# EasyEDA Pro project Athena.eprj, board PCB
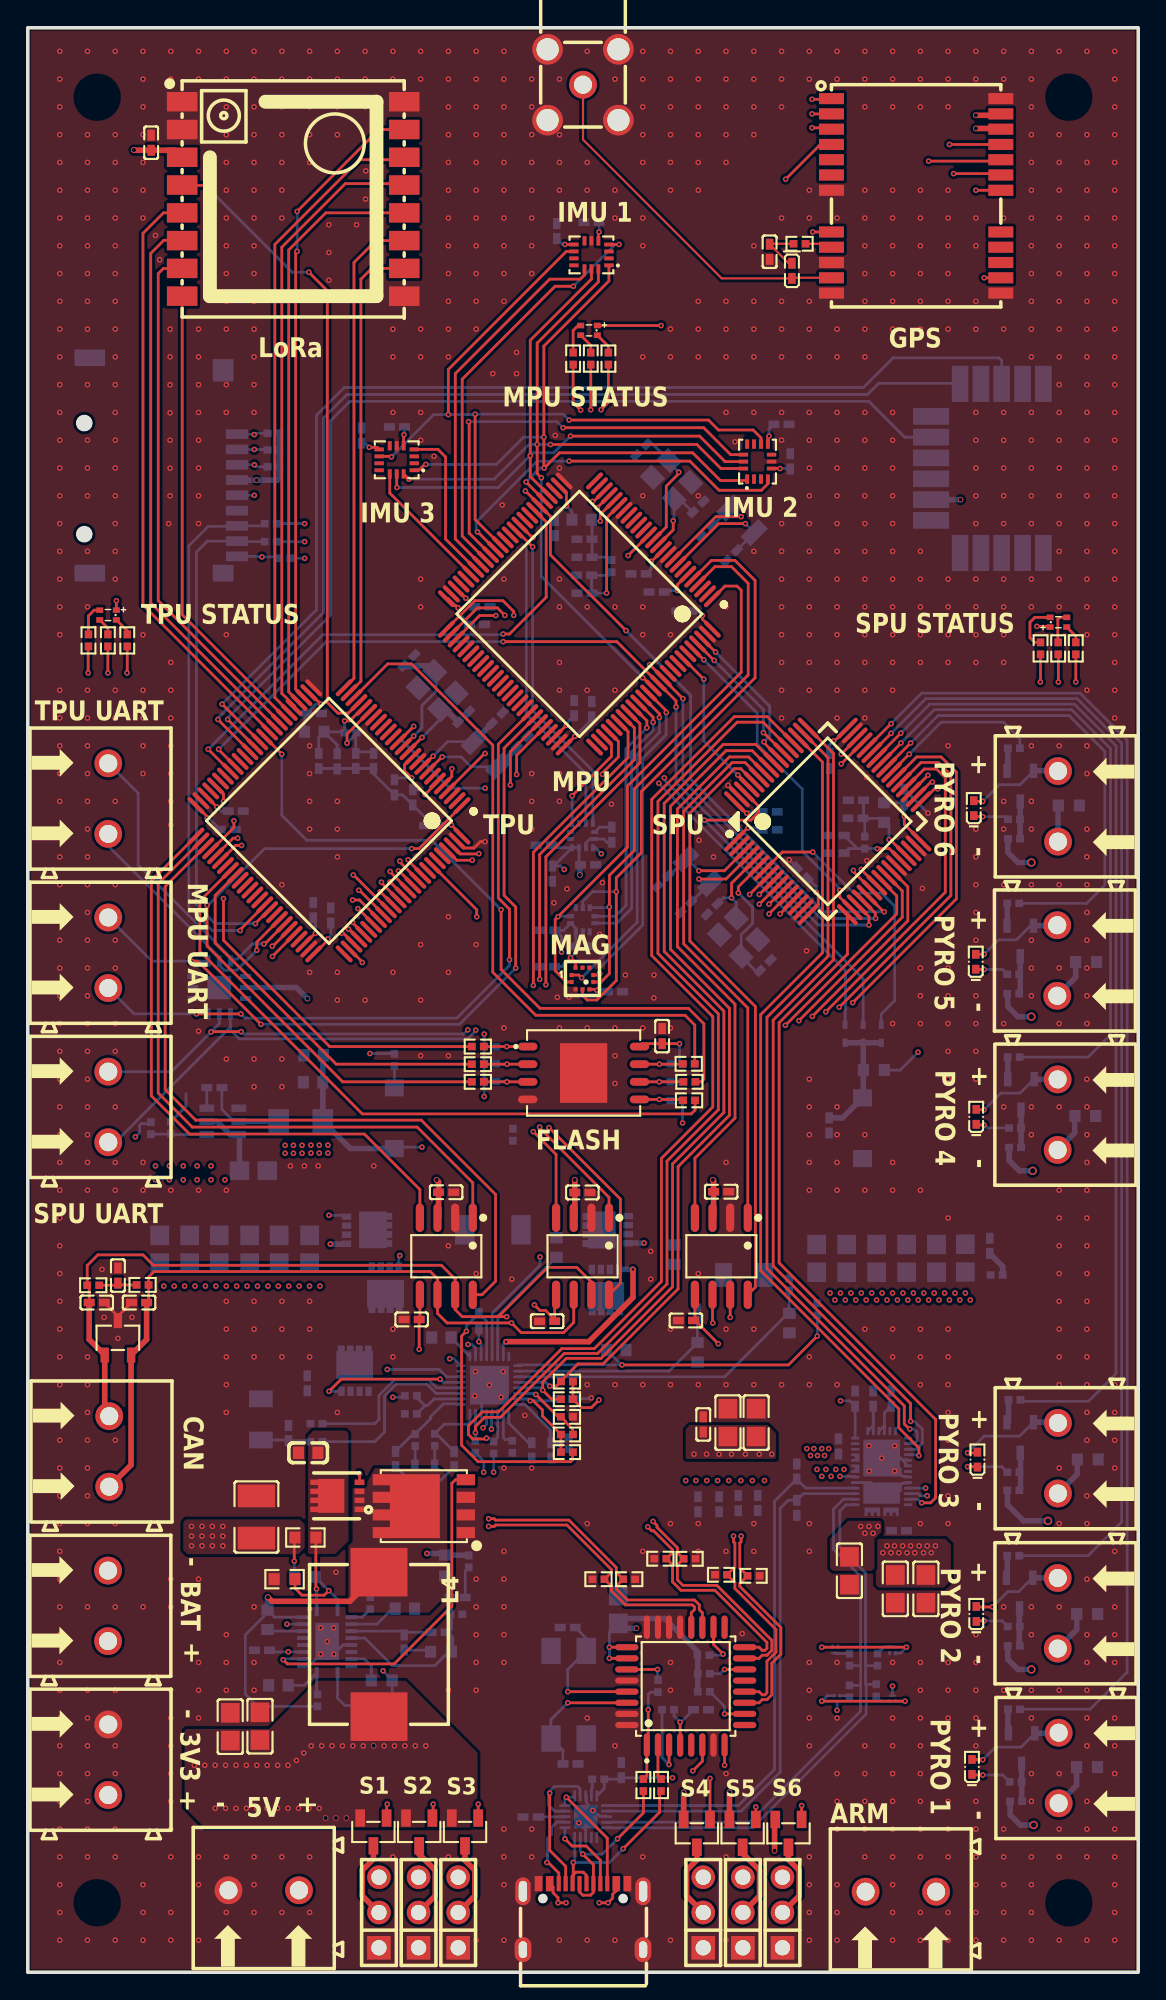
[diagram p4: board, top side]
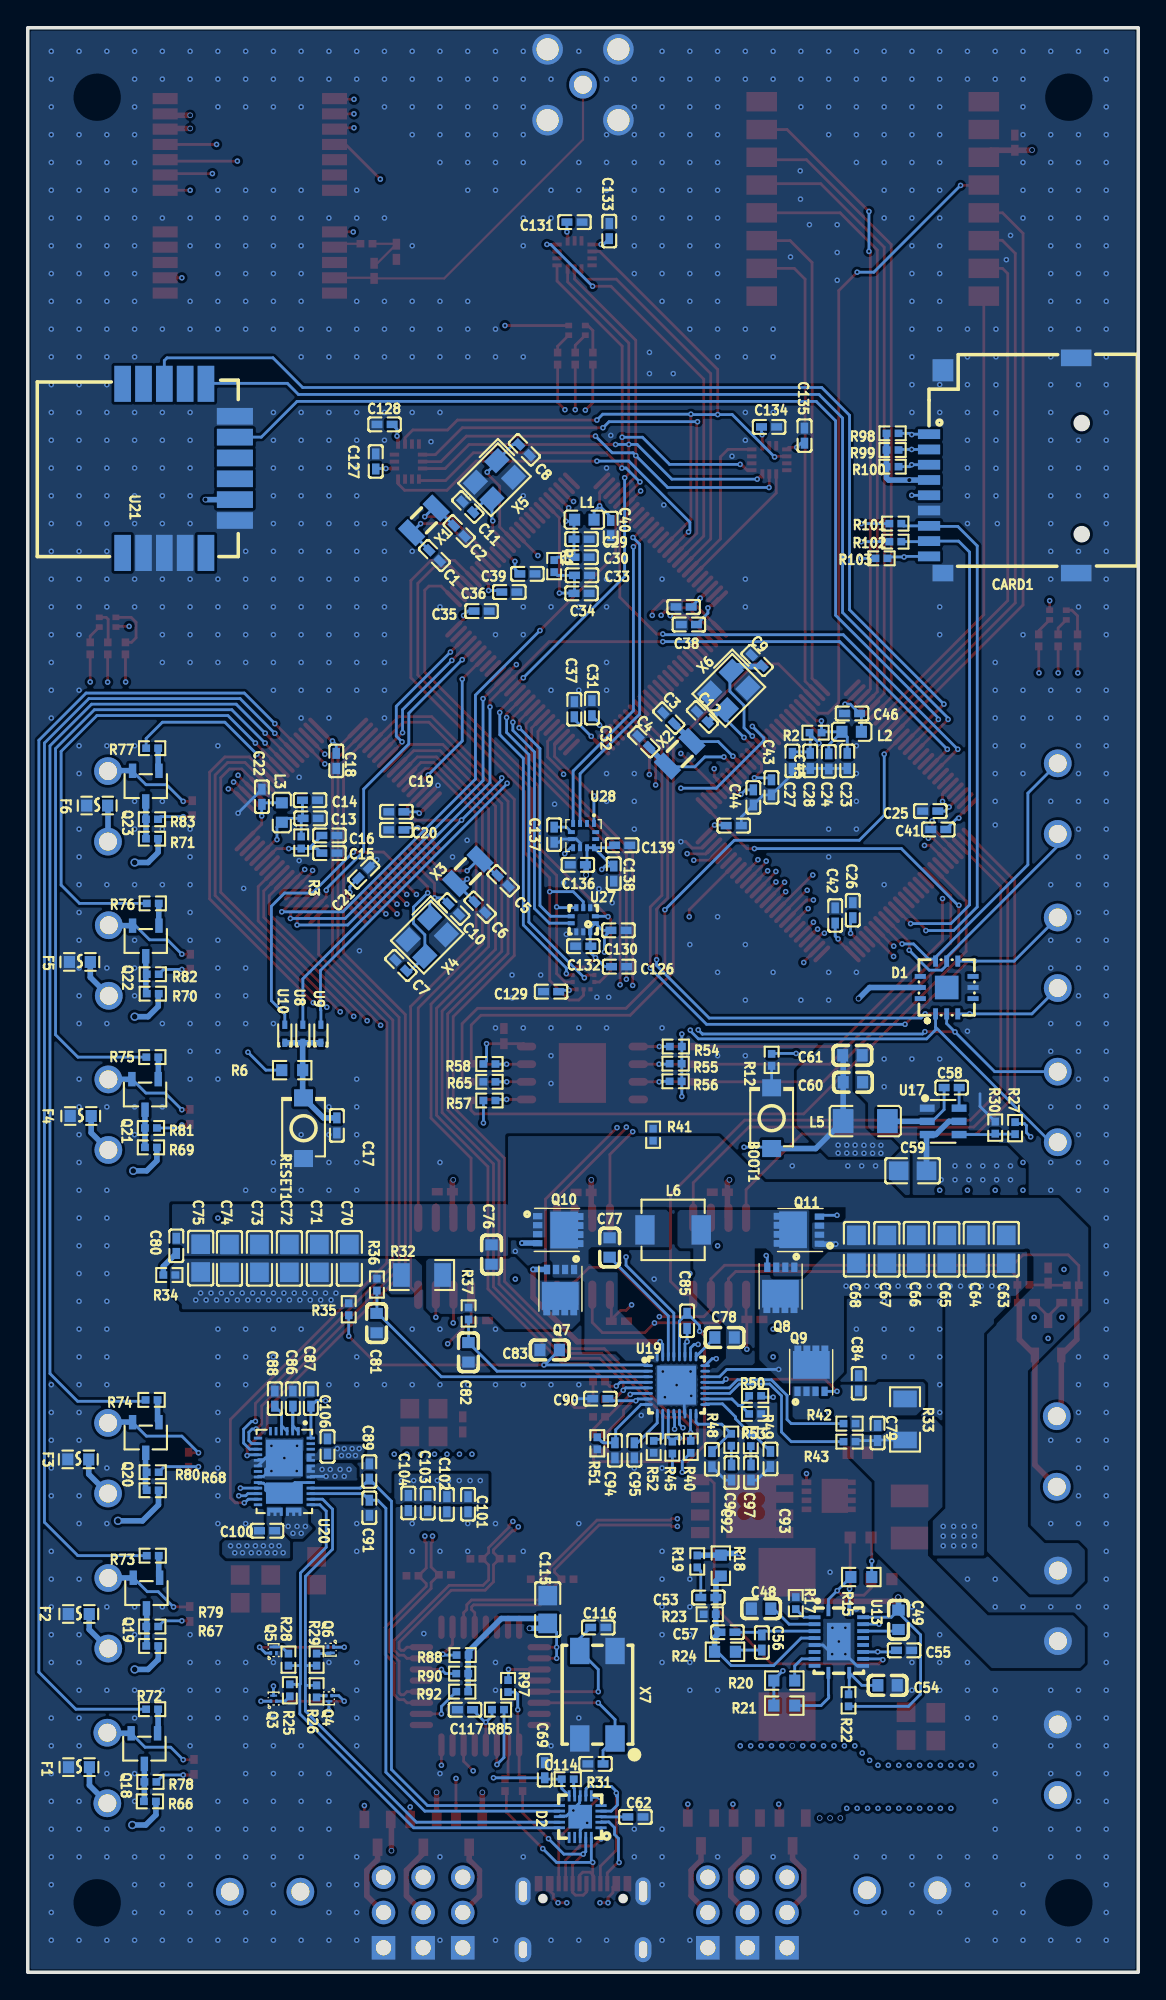
[diagram p5: board, bottom side, seen from below]

Outline 80 x 140 mm; copper layers: Top Layer, GND, POWER, SIGNAL, GND2, Bottom Layer. Coordinates in mm from the lower left corner of the outline.
Outline path: rectangle 0,140 80,0
Stack: Top Layer 0.035mm Outer layer thickness 1oz / Dielectric1 0.0994mm 3313 RC57% 4.2mil / GND 0.0152mm Inner layer thickness / Dielectric2 0.55mm 0.55mm H/H No copper / POWER 0.0152mm Inner layer thickness / Dielectric3 0.1088mm 2116 RC54% 4.9mil / SIGNAL 0.0152mm Inner layer thickness / Dielectric4 0.55mm 0.55mm H/H No copper / GND2 0.0152mm Inner layer thickness / Dielectric5 0.0994mm 3313 RC57% 4.2mil / Bottom Layer 0.035mm Outer layer thickness 1oz

## Design rules (mm)
net TPU_DP: DP1
net TPU_DM: DP1
net MPU_DP: DP2
net MPU_DM: DP2
net SPU_DP: DP3
net SPU_DM: DP3
template: Custom Config
spacing copperThickness1oz (default): track to track 0.102, other pairs 0.152 to 0.3
spacing copperThickness2oz: track to track 0.203, other pairs 0.152 to 0.3
spacing copperThicknessInner0.5oz: track to track 0.089, other pairs 0.152 to 0.3
track width copperThickness1oz (default): min 0.102, default 0.254, max 2.54
track width copperThickness2oz: min 0.203, default 0.254, max 2.54
track width copperThickness0.5oz: min 0.089, default 0.254, max 2.54
differential pair differentialPair (default): width min 0.127, default 0.254, max 2.54; gap min 0.152, default 0.152
via viaSize (default): diameter min 0.4, default 0.4, max 10; hole min 0.2, default 0.2, max 6.3

## Placement (name value [footprint] x y rotation side)
ARM1  WJ500V-5.08-2P  [CONN-TH_2P-P5.00_WJ500V-5.08-2P]  62.9 5.8 180 top
BOOT1  6.8pF  [SW-SMD_L3.9-W3.0-P4.45]  26.41 61.49 90 bottom
C1  6.8pF  [C0402]  50.7 102 225 bottom
C2  6.8pF  [C0402]  48.92 103.77 225 bottom
C3  6.8pF  [C0402]  35.62 88.6 45 bottom
C4  6.8pF  [C0402]  33.82 90.3 45 bottom
C5  6.8pF  [C0402]  45.76 78.58 225 bottom
C6  6.8pF  [C0402]  47.42 76.68 225 bottom
C7  20pF  [C0402]  53.12 72.49 45 bottom
C8  20pF  [C0402]  44.22 109.61 225 bottom
C9  20pF  [C0402]  27.46 94.45 45 bottom
C10  20pF  [C0402]  49.31 76.55 225 bottom
C11  3.9pF  [C0402]  48.3 105.5 45 bottom
C12  20pF  [C0402]  31.4 90.38 45 bottom
C13  100nF  [C0402]  59.63 83.08 180 bottom
C14  1uF  [C0402]  59.66 84.39 0 bottom
C15  100nF  [C0402]  58.27 80.58 180 bottom
C16  1uF  [C0402]  58.27 81.85 0 bottom
C17  100nF  [C0402]  57.73 60.97 270 bottom
C18  100nF  [C0402]  57.78 87.21 270 bottom
C19  100nF  [C0402]  53.45 83.55 0 bottom
C20  100nF  [C0402]  53.45 82.25 0 bottom
C21  100nF  [C0402]  55.8 79.15 135 bottom
C22  4.7uF  [C0402]  63.13 84.63 270 bottom
C23  100nF  [C0402]  20.96 87.22 270 bottom
C24  1uF  [C0402]  22.29 87.18 90 bottom
C25  2.2uF  [C0402]  14.98 83.6 0 bottom
C26  2.2uF  [C0402]  20.56 76.47 90 bottom
C27  100nF  [C0402]  24.91 87.21 270 bottom
C28  1uF  [C0402]  23.63 87.22 90 bottom
C29  100nF  [C0402]  40.1 103.18 180 bottom
C30  1uF  [C0402]  40.1 101.88 0 bottom
C31  2.2uF  [C0402]  39.36 91.01 90 bottom
C32  2.2uF  [C0402]  32.75 98.3 0 bottom
C33  100nF  [C0402]  40.07 100.58 180 bottom
C34  1uF  [C0402]  40.1 99.28 0 bottom
C35  100nF  [C0402]  47.3 98 180 bottom
C36  100nF  [C0402]  45.31 99.37 180 bottom
C37  100nF  [C0402]  40.63 90.94 90 bottom
C38  100nF  [C0402]  32.37 97.03 0 bottom
C39  100nF  [C0402]  44 100.68 180 bottom
C40  4.7uF  [C0402]  38 103.98 90 bottom
C41  100nF  [C0402]  14.41 82.28 0 bottom
C42  100nF  [C0402]  21.83 76.09 90 bottom
C43  100nF  [C0402]  26.42 85.31 270 bottom
C44  100nF  [C0402]  27.73 84.59 270 bottom
C45  100nF  [C0402]  29.14 82.56 180 bottom
C46  4.7uF  [C0402]  20.62 90.63 180 bottom
C47  4.7uF  [C1210]  16.47 32.78 270 top
C48  56nF  [C0603]  27.17 26.18 180 bottom
C49  100nF  [C0603]  17.27 25.38 270 bottom
C50  100nF  [C0603]  20.2 37.4 0 top
C51  22uF  [C0805]  16.73 17.71 270 top
C52  22uF  [C0805]  14.59 17.68 270 top
C53  390pF  [C0402]  30.97 26.98 180 bottom
C54  10pF  [C0603]  18.06 20.66 0 bottom
C55  2.2uF  [C0402]  16.87 23.18 0 bottom
C56  8.2nF  [C0402]  27.12 23.74 270 bottom
C57  1nF  [C0402]  29.59 24.48 0 bottom
C58  100nF  [C0402]  13.44 63.69 0 bottom
C59  2.2uF  [C0805]  16.25 57.71 0 bottom
C60  10uF  [C0603]  20.55 64.08 180 bottom
C61  10uF  [C0603]  20.59 66.02 180 bottom
C62  100nF  [C0402]  36.22 11.18 180 bottom
C63  10uF  [C0805]  9.51 52.06 90 bottom
C64  47nF  [C0805]  11.67 52.06 90 bottom
C65  1uF  [C0805]  13.79 52.05 90 bottom
C66  100pF  [C0805]  15.98 52.06 90 bottom
C67  10nF  [C0805]  18.11 52.05 90 bottom
C68  10uF  [C0805]  20.3 52.06 90 bottom
C69  1uF  [C0402]  42.75 14.54 90 bottom
C70  10uF  [C0805]  56.83 51.4 90 bottom
C71  10uF  [C0805]  58.99 51.4 90 bottom
C72  10uF  [C0805]  61.15 51.4 90 bottom
C73  10uF  [C0805]  63.31 51.4 90 bottom
C74  10uF  [C0805]  65.47 51.4 90 bottom
C75  10uF  [C0805]  67.55 51.42 90 bottom
C76  6.8pF  [C0603]  46.59 51.67 90 bottom
C77  6.8pF  [C0603]  38.08 52.18 90 bottom
C78  20pF  [C0603]  29.8 45.7 180 bottom
C79  47nF  [C0402]  18.78 38.82 90 bottom
C80  1uF  [C0402]  69.3 52.3 90 bottom
C81  2.2uF  [C0603]  54.87 46.74 90 bottom
C82  33nF  [C0603]  48.25 44.63 90 bottom
C83  470nF  [C0603]  42.4 44.8 180 bottom
C84  1uF  [C0402]  20.13 42.4 90 bottom
C85  15pF  [C0402]  32.5 46.9 270 bottom
C86  10uF  [C0402]  60.9 41.3 90 bottom
C87  10uF  [C0402]  59.6 41.3 90 bottom
C88  10uF  [C0402]  62.2 41.3 90 bottom
C89  330pF  [C0402]  55.39 36.05 90 bottom
C90  1uF  [C0402]  38.75 41.29 0 bottom
C91  330pF  [C0402]  55.39 33.44 270 bottom
C92  33pF  [C0402]  30.72 36.94 270 bottom
C93  15pF  [C0402]  26.5 36.95 270 bottom
C94  100pF  [C0402]  37.7 37.57 270 bottom
C95  100pF  [C0402]  36.3 37.57 270 bottom
C96  1.8nF  [C0402]  29.3 35.98 270 bottom
C97  680pF  [C0402]  27.9 35.98 270 bottom
C98  22uF  [C0805]  64.7 27.6 270 top
C99  22uF  [C0805]  62.5 27.6 270 top
C100  100nF  [C0402]  62.76 31.79 0 bottom
C101  100nF  [C0402]  48.28 33.69 270 bottom
C102  100nF  [C0402]  49.81 33.69 270 bottom
C103  100nF  [C0402]  51.19 33.77 270 bottom
C104  100nF  [C0402]  52.58 33.78 270 bottom
C105  10uF  [C0805]  59.19 28.9 270 top
C106  10nF  [C0402]  58.41 37.86 90 bottom
C107  10nF  [C0402]  48.66 39.44 90 top
C108  100nF  [C0805]  52.47 39.57 90 top
C109  100nF  [C0805]  50.44 39.57 90 top
C110  100nF  [C0402]  45.7 67.4 90 top
C111  47pF  [C0402]  53.44 123.87 270 top
C112  100nF  [C0402]  39.95 56.14 0 top
C113  100nF  [C0402]  37.41 46.87 180 top
C114  18pF  [C0402]  39.1 15 0 bottom
C115  10uF  [C0805]  42.54 26.12 90 bottom
C116  18pF  [C0402]  38.9 24.82 180 bottom
C117  100nF  [C0402]  48.5 18.9 0 bottom
C118  100nF  [C0402]  8.89 131.73 90 top
C119  100nF  [C0402]  49.95 56.2 0 top
C120  100nF  [C0402]  47.41 46.93 180 top
C121  100nF  [C0402]  30.14 56.16 0 top
C122  100nF  [C0402]  27.65 47 180 top
C123  100nF  [C0402]  8.02 48.22 180 top
C124  100nF  [C0402]  6.49 50.16 90 top
C125  100nF  [C0402]  4.97 48.22 180 top
C126  100nF  [C0402]  37.4 72.4 0 bottom
C127  100nF  [C0402]  54.93 108.78 90 bottom
C128  100nF  [C0402]  54.3 111.44 0 bottom
C129  100nF  [C0402]  42.3 70.6 180 bottom
C130  100nF  [C0402]  37.44 75.02 180 bottom
C131  100nF  [C0402]  40.61 126.01 180 bottom
C132  100nF  [C0402]  39.98 73.87 180 bottom
C133  100nF  [C0402]  38.11 125.36 90 bottom
C134  100nF  [C0402]  26.59 111.26 180 bottom
C135  100nF  [C0402]  24.04 110.64 90 bottom
C136  100nF  [C0402]  40.37 79.73 180 bottom
C137  220nF  [C0402]  42.08 81.9 270 bottom
C138  100nF  [C0402]  37.79 79.1 270 bottom
C139  100nF  [C0402]  37.18 81.14 180 bottom
CAN1  WJ500V-5.08-2P  [CONN-TH_2P-P5.00_WJ500V-5.08-2P]  5.87 37.5 90 top
CARD1  TF PUSH  [TF-SMD_TF-PUSH]  9.77 108.49 90 bottom
D1  TPD6E001RSFR  [QFN-12_L4.0-W4.0-P0.80-BL-EP1.7]  13.8 70.9 180 bottom
D2  TPD6S300RUKR  [WQFN-20_L3.0-W3.0-P0.40-BL-EP1.7]  40.2 11.2 90 bottom
D3  PESD1CAN  [SOT-23-3_L2.9-W1.6-P1.90-LS2.8-BR]  6.49 45.68 270 top
F1  0438005.WRGT  [F0603]  76.31 14.76 0 bottom
F2  0438005.WRGT  [F0603]  76.32 25.79 0 bottom
F3  0438005.WRGT  [F0603]  76.36 36.92 0 bottom
F4  0438005.WRGT  [F0603]  76.18 61.65 0 bottom
F5  0438005.WRGT  [F0603]  76.25 72.74 0 bottom
F6  0438005.WRGT  [F0603]  75 84 0 bottom
FLASH1  W25Q256JVEIQ  [WSON-8_L8.0-W6.10-P1.27-BL-EP]  40.04 64.74 270 top
GPS1  NEO-M8U-06B  [GPSM-SMD_24P-L16.0-W12.2-P1.10-TL]  64 127.9 0 top
IMU1  ICM-45686  [LGA-14_L3.0-W2.5-P0.50-TL]  52.57 108.77 90 top
IMU2  ICM-45686  [LGA-14_L3.0-W2.5-P0.50-TL]  40.61 123.65 180 top
IMU3  ICM-45686  [LGA-14_L3.0-W2.5-P0.50-TL]  26.58 108.89 180 top
L1  FCM1608KF-601T03  [L0603]  39.9 104.58 180 bottom
L2  FCM1608KF-601T03  [L0603]  20.64 89.31 180 bottom
L3  FCM1608KF-601T03  [L0603]  61.7 83.5 90 bottom
L4  1.5uH  [IND-SMD_L11.5-W10.0_104CDMCCDS]  25.3 23.6 270 top
L5  2.2uH  [L1206]  19.66 61.28 0 bottom
L6  2.2uH  [IND-SMD_L4.4-W4.2]  33.51 53.45 0 bottom
L7  27nH  [L0402-RD]  55.05 122.5 270 top
MAG1  ICP-20100  [LGA-10_L2.0-W2.0-P0.50-TL_ICP-20100]  39.96 71.55 0 top
P1  WJ500V-5.08-2P  [CONN-TH_2P-P5.00_WJ500V-5.08-2P]  74.27 14.7 270 top
P2  WJ500V-5.08-2P  [CONN-TH_2P-P5.00_WJ500V-5.08-2P]  74.2 25.84 270 top
P3  WJ500V-5.08-2P  [CONN-TH_2P-P5.00_WJ500V-5.08-2P]  74.22 37.01 270 top
P4  WJ500V-5.08-2P  [CONN-TH_2P-P5.00_WJ500V-5.08-2P]  74.19 61.74 270 top
P5  WJ500V-5.08-2P  [CONN-TH_2P-P5.00_WJ500V-5.08-2P]  74.16 72.84 270 top
P6  WJ500V-5.08-2P  [CONN-TH_2P-P5.00_WJ500V-5.08-2P]  74.22 83.94 270 top
PYRO1  NCD0402R1  [LED0402-RD]  68.02 14.78 90 top
PYRO2  NCD0402R1  [LED0402-RD]  68.33 25.79 90 top
PYRO3  NCD0402R1  [LED0402-RD]  68.42 36.91 90 top
PYRO4  NCD0402R1  [LED0402-RD]  68.33 61.59 90 top
PYRO5  NCD0402R1  [LED0402-RD]  68.29 72.76 90 top
PYRO6  NCD0402R1  [LED0402-RD]  68.15 83.81 90 top
Q1  CSD17575Q3  [VSON-CLIP-8_L3.3-W3.3-P0.65-BL]  22.3 34.3 90 top
Q2  CSD17573Q5B  [POWERVDFN-8_L6.0-W5.0-P1.27-BL]  28.53 33.56 90 top
Q3  CSD25480F3  [PICOSTAR-3_L0.7-W0.6-P0.40-TL]  62.29 19.71 90 bottom
Q4  CSD25480F3  [PICOSTAR-3_L0.7-W0.6-P0.40-TL]  58.31 19.71 270 bottom
Q5  CSD15380F3  [PICOSTAR-3_L0.7-W0.6-P0.35-TL]  62.29 23.2 90 bottom
Q6  CSD15380F3  [PICOSTAR-3_L0.7-W0.6-P0.35-TL]  58.18 23.21 270 bottom
Q7  CSD17577Q3A  [VSONP-8_L3.1-W3.1-P0.65-LS3.5-BL]  41.63 49.09 0 bottom
Q8  CSD17577Q3A  [VSONP-8_L3.1-W3.1-P0.65-LS3.5-BL]  25.76 49.26 0 bottom
Q9  CSD25402Q3A  [VSONP-8_L3.1-W3.1-P0.65-LS3.5-BL]  23.56 43.32 180 bottom
Q10  CSD17577Q3A  [VSONP-8_L3.1-W3.1-P0.65-LS3.5-BL]  41.76 53.45 270 bottom
Q11  CSD17577Q3A  [VSONP-8_L3.1-W3.1-P0.65-LS3.5-BL]  24.46 53.44 90 bottom
Q12  IRLML6402TRPBF  [SOT-23-3_L2.9-W1.3-P1.90-LS2.4-BR]  24.9 10.1 90 top
Q13  IRLML6402TRPBF  [SOT-23-3_L2.9-W1.3-P1.90-LS2.4-BR]  28.2 10.1 90 top
Q14  IRLML6402TRPBF  [SOT-23-3_L2.9-W1.3-P1.90-LS2.4-BR]  31.5 10.1 90 top
Q15  IRLML6402TRPBF  [SOT-23-3_L2.9-W1.3-P1.90-LS2.4-BR]  48.2 10 90 top
Q16  IRLML6402TRPBF  [SOT-23-3_L2.9-W1.3-P1.90-LS2.4-BR]  51.5 10 90 top
Q17  IRLML6402TRPBF  [SOT-23-3_L2.9-W1.3-P1.90-LS2.4-BR]  54.8 10 90 top
Q18  L2N7002SLLT1G  [SOT-23-3_L3.0-W1.7-P0.95-LS2.9-BR]  71.6 16.1 90 bottom
Q19  L2N7002SLLT1G  [SOT-23-3_L3.0-W1.7-P0.95-LS2.9-BR]  71.45 27.3 90 bottom
Q20  L2N7002SLLT1G  [SOT-23-3_L3.0-W1.7-P0.95-LS2.9-BR]  71.5 38.5 90 bottom
Q21  L2N7002SLLT1G  [SOT-23-3_L3.0-W1.7-P0.95-LS2.9-BR]  71.55 63.2 90 bottom
Q22  L2N7002SLLT1G  [SOT-23-3_L3.0-W1.7-P0.95-LS2.9-BR]  71.5 74.25 90 bottom
Q23  L2N7002SLLT1G  [SOT-23-3_L3.0-W1.7-P0.95-LS2.9-BR]  71.5 85.4 90 bottom
R1  0Ω  [R0402]  42.08 101.24 270 bottom
R2  0Ω  [R0402]  23.25 89.25 0 bottom
R3  0Ω  [R0402]  60.3 81.34 270 bottom
R4  100Ω  [R0402]  72.96 95.32 90 top
R5  100Ω  [R0402]  74.23 95.32 270 top
R6  10kΩ  [R0603]  60.95 64.95 0 bottom
R7  100Ω  [R0402]  75.5 95.32 270 top
R8  100Ω  [R0402]  41.83 116.18 90 top
R9  100Ω  [R0402]  40.56 116.18 270 top
R10  100Ω  [R0402]  7.17 95.89 90 top
R11  100Ω  [R0402]  5.77 95.89 270 top
R12  10kΩ  [R0402]  26.41 65.69 90 bottom
R13  100Ω  [R0402]  39.29 116.18 270 top
R14  100Ω  [R0402]  4.37 95.89 270 top
R15  32.4kΩ  [R0603]  19.95 28.45 180 bottom
R16  9.31kΩ  [R0603]  18.5 28.3 0 top
R17  39.2kΩ  [R0402]  24.67 26.58 270 bottom
R18  18kΩ  [R0603]  30.07 29.28 90 bottom
R19  130Ω  [R0402]  31.77 29.58 90 bottom
R20  20kΩ  [R0603]  25.5 21 180 bottom
R21  20kΩ  [R0603]  25.5 19.2 180 bottom
R22  750Ω  [R0402]  20.87 19.58 270 bottom
R23  3.4kΩ  [R0402]  30.87 25.78 180 bottom
R24  1.4kΩ  [R0603]  29.77 23.08 0 bottom
R25  100kΩ  [R0402]  61.12 20.3 270 bottom
R26  100kΩ  [R0402]  59.19 20.22 270 bottom
R27  100kΩ  [R0402]  8.87 60.77 90 bottom
R28  1MΩ  [R0402]  61.22 22.51 270 bottom
R29  1MΩ  [R0402]  59.19 22.51 270 bottom
R30  22.1kΩ  [R0402]  10.3 60.81 270 bottom
R31  100kΩ  [R0402]  41.1 13.9 180 bottom
R32  10mΩ  [R1206]  51.6 50.2 180 bottom
R33  10mΩ  [R1206]  16.8 39.8 270 bottom
R34  2.2Ω  [R0402]  69.8 50.2 0 bottom
R35  1Ω  [R0402]  56.88 47.73 90 bottom
R36  4.99Ω  [R0402]  54.85 49.51 90 bottom
R37  4.99Ω  [R0402]  48.24 47.43 90 bottom
R38  10kΩ  [R0402]  38.84 42.53 0 top
R39  10kΩ  [R0402]  38.84 41.26 0 top
R40  10kΩ  [R0402]  32.24 37.83 270 bottom
R41  0Ω  [R0402]  34.95 60.3 270 bottom
R42  10Ω  [R0402]  20.8 39.5 180 bottom
R43  10Ω  [R0402]  20.8 38.2 180 bottom
R44  10kΩ  [R0402]  38.84 37.45 180 top
R45  50kΩ  [R0402]  33.56 37.78 270 bottom
R46  383kΩ  [R0402]  38.84 38.72 180 top
R47  280kΩ  [R0402]  38.84 39.99 0 top
R48  40.2kΩ  [R0402]  29.32 38.34 90 bottom
R49  10kΩ  [R0402]  27.91 38.31 90 bottom
R50  348kΩ  [R0402]  27.6 41.5 180 bottom
R51  137kΩ  [R0402]  38.97 38.08 270 bottom
R52  30kΩ  [R0402]  34.91 37.83 270 bottom
R53  249kΩ  [R0402]  27.6 40.2 0 bottom
R54  10kΩ  [R0402]  33.31 66.65 180 bottom
R55  10kΩ  [R0402]  33.33 65.42 180 bottom
R56  10kΩ  [R0402]  33.33 64.15 180 bottom
R57  10kΩ  [R0402]  46.74 62.76 0 bottom
R58  10kΩ  [R0402]  46.74 65.39 0 bottom
R59  50Ω  [R0402]  32.43 66.65 0 top
R60  50Ω  [R0402]  32.43 65.38 0 top
R61  50Ω  [R0402]  32.43 64.11 0 top
R62  50Ω  [R0402]  47.62 65.41 0 top
R63  50Ω  [R0402]  47.66 64.11 0 top
R64  50Ω  [R0402]  47.64 62.78 0 top
R65  100kΩ  [R0402]  46.74 64.11 180 bottom
R66  10kΩ  [R0402]  71.2 12.3 0 bottom
R67  10kΩ  [R0402]  71.03 23.49 0 bottom
R68  10kΩ  [R0402]  71 34.7 0 bottom
R69  10kΩ  [R0402]  71.13 59.39 0 bottom
R70  10kΩ  [R0402]  70.99 70.46 0 bottom
R71  10kΩ  [R0402]  71.05 81.61 0 bottom
R72  100Ω  [R0402]  71.04 18.94 180 bottom
R73  100Ω  [R0402]  71 29.99 180 bottom
R74  100Ω  [R0402]  71.08 41.21 180 bottom
R75  100Ω  [R0402]  71.03 65.89 180 bottom
R76  100Ω  [R0402]  70.99 76.96 180 bottom
R77  100Ω  [R0402]  71.04 88.13 180 bottom
R78  1kΩ  [R0402]  71.17 13.7 180 bottom
R79  1kΩ  [R0402]  71.03 24.89 180 bottom
R80  1kΩ  [R0402]  71 36 180 bottom
R81  1kΩ  [R0402]  71.13 60.79 180 bottom
R82  1kΩ  [R0402]  70.99 71.86 180 bottom
R83  1kΩ  [R0402]  71.05 83.01 180 bottom
R84  10Ω  [R0402]  55.6 124.45 0 top
R85  15kΩ  [R0402]  46.12 18.91 180 bottom
R86  15kΩ  [R0402]  41.12 28.3 0 top
R87  15kΩ  [R0402]  43.33 28.3 180 top
R88  10kΩ  [R0402]  48.68 22.83 180 bottom
R89  15kΩ  [R0402]  45.57 29.77 0 top
R90  10kΩ  [R0402]  48.7 21.5 180 bottom
R91  15kΩ  [R0402]  47.68 29.77 180 top
R92  10kΩ  [R0402]  48.7 20.2 180 bottom
R93  15kΩ  [R0402]  49.95 28.62 0 top
R94  15kΩ  [R0402]  52.29 28.54 180 top
R95  27Ω  [R0402]  44.35 13.48 90 top
R96  27Ω  [R0402]  45.62 13.48 90 top
R97  1.5kΩ  [R0402]  45.4 20.6 270 bottom
R98  10kΩ  [R0402]  17.7 110.8 0 bottom
R99  10kΩ  [R0402]  17.7 109.6 0 bottom
R100  10kΩ  [R0402]  17.7 108.4 0 bottom
R101  10kΩ  [R0402]  17.5 104.3 0 bottom
R102  10kΩ  [R0402]  17.5 103 0 bottom
R103  10kΩ  [R0402]  18.5 101.8 0 bottom
R104  60.4Ω  [R0402]  8.27 49.49 0 top
R105  60.4Ω  [R0402]  4.72 49.46 0 top
RESET1  TS-1088-AR02016  [SW-SMD_L3.9-W3.0-P4.45]  60.13 60.77 90 bottom
RF1  BWSMA-KWE-Z001  [SMA-TH_BWSMA-KWE-Z001]  40 135.9 90 top
S1  PZ254V-11-03P  [HDR-TH_3P-P2.54-V-M]  25.3 4.3 90 top
S2  PZ254V-11-03P  [HDR-TH_3P-P2.54-V-M]  28.15 4.3 90 top
S3  PZ254V-11-03P  [HDR-TH_3P-P2.54-V-M]  31.01 4.3 90 top
S4  PZ254V-11-03P  [HDR-TH_3P-P2.54-V-M]  48.66 4.3 90 top
S5  PZ254V-11-03P  [HDR-TH_3P-P2.54-V-M]  51.52 4.3 90 top
S6  PZ254V-11-03P  [HDR-TH_3P-P2.54-V-M]  54.37 4.3 90 top
U1  STM32H753VIT6  [LQFP-100_L14.0-W14.0-P0.50-LS16.0-BL]  39.74 97.79 135 top
U2  STM32H743VIT6  [LQFP-100_L14.0-W14.0-P0.50-LS16.0-BL]  21.7 82.9 135 top
U3  STM32G474RET6  [LQFP-64_L10.0-W10.0-P0.50-LS12.0-BL]  57.63 82.86 315 top
U4  WJ500V-5.08-2P  [CONN-TH_2P-P5.00_WJ500V-5.08-2P]  5.8 73.4 90 top
U5  WJ500V-5.08-2P  [CONN-TH_2P-P5.00_WJ500V-5.08-2P]  5.8 84.5 90 top
U6  WJ500V-5.08-2P  [CONN-TH_2P-P5.00_WJ500V-5.08-2P]  5.8 62.3 90 top
U7  XL-1608RGBC  [LED-SMD_4P-L1.6-W0.8-BL]  74.25 97.2 0 top
U8  1SV325,H3F(T  [SOD-523_L1.2-W0.8-LS1.6-RD]  60.18 67.57 90 bottom
U9  1SV325,H3F(T  [SOD-523_L1.2-W0.8-LS1.6-RD]  58.88 67.57 90 bottom
U10  1SV325,H3F(T  [SOD-523_L1.2-W0.8-LS1.6-RD]  61.48 67.57 90 bottom
U11  XL-1608RGBC  [LED-SMD_4P-L1.6-W0.8-BL]  40.43 118.21 180 top
U12  XL-1608RGBC  [LED-SMD_4P-L1.6-W0.8-BL]  5.78 97.72 180 top
U13  LM5145RGYR  [VQFN-20_L4.5-W3.5-P0.50-BL-EP]  21.57 23.81 270 bottom
U14  2.1Ω  [R0603]  20 31.3 180 top
U15  WJ500V-5.08-2P  [CONN-TH_2P-P5.00_WJ500V-5.08-2P]  5.8 15.3 90 top
U16  WJ500V-5.08-2P  [CONN-TH_2P-P5.00_WJ500V-5.08-2P]  5.78 26.38 90 top
U17  LMR51430XDDCR  [SOT-23-6_L2.9-W1.6-P0.95-LS2.8-BL]  14.05 61.26 270 bottom
U18  WJ500V-5.08-2P  [CONN-TH_2P-P5.00_WJ500V-5.08-2P]  17 5.9 180 top
U19  BQ25713RSNR  [QFN-32_L4.0-W4.0-P0.40-TL-EP2.8]  33.26 42.27 180 bottom
U20  TPS25751DREFR  [QFN-38_L6.0-W4.0-P0.40-TL-EP_TI_REF0038A]  61.51 36.06 270 bottom
U21  DA14531MOD-00F01002  [WIRELM-SMD-16_L14.5-W12.5-P1.50-DA14531MOD]  69.12 108.28 90 bottom
U22  TCAN1057AVDRQ1  [SOIC-8_L4.9-W3.9-P1.27-LS6.0-BL]  39.97 51.55 180 top
U23  TUSB2036VFR  [LQFP-32_L7.0-W7.0-P0.80-LS9.0-BL]  47.4 20.6 0 top
U24  Ra-02  [WIRELM-SMD_RA-02-BL]  19.12 127.68 270 top
U25  TCAN1057AVDRQ1  [SOIC-8_L4.9-W3.9-P1.27-LS6.0-BL]  49.97 51.55 180 top
U26  TCAN1057AVDRQ1  [SOIC-8_L4.9-W3.9-P1.27-LS6.0-BL]  30.15 51.55 180 top
U27  BMP388  [SENSORM-SMD_BMP388]  39.98 75.78 270 bottom
U28  LIS2MDLTR  [LGA-12_L2.0-W2.0-P0.50-BL]  39.96 81.84 0 bottom
USB1  TYPE-C 16PIN 2MD(073)  [USB-C-SMD_TYPE-C-6PIN-2MD-073]  40 4 0 top
X1  32.768kHz  [FC-135R_L3.2-W1.5]  51.46 104.53 315 bottom
X2  32.768kHz  [FC-135R_L3.2-W1.5]  33.03 87.72 315 bottom
X3  32.768kHz  [FC-135R_L3.2-W1.5]  48.3 79.27 135 bottom
X4  24MHz  [CRYSTAL-SMD_4P-L3.2-W2.5-BL]  51.22 74.52 315 bottom
X5  25MHz  [CRYSTAL-SMD_4P-L3.2-W2.5-BL]  46.38 107.45 315 bottom
X6  25MHz  [CRYSTAL-SMD_4P-L3.2-W2.5-BL]  29.49 92.29 315 bottom
X7  6MHz  [OSC-SMD_4P-L7.0-W5.0-BL_ABMM]  38.96 19.98 90 bottom
